# Altium schematic sheet Processor.SchDoc
size 594 x 420 mm; Author: ALTIUM GOSTBOM2.0 KEV; SheetNumber: 17; SheetTotal: 48
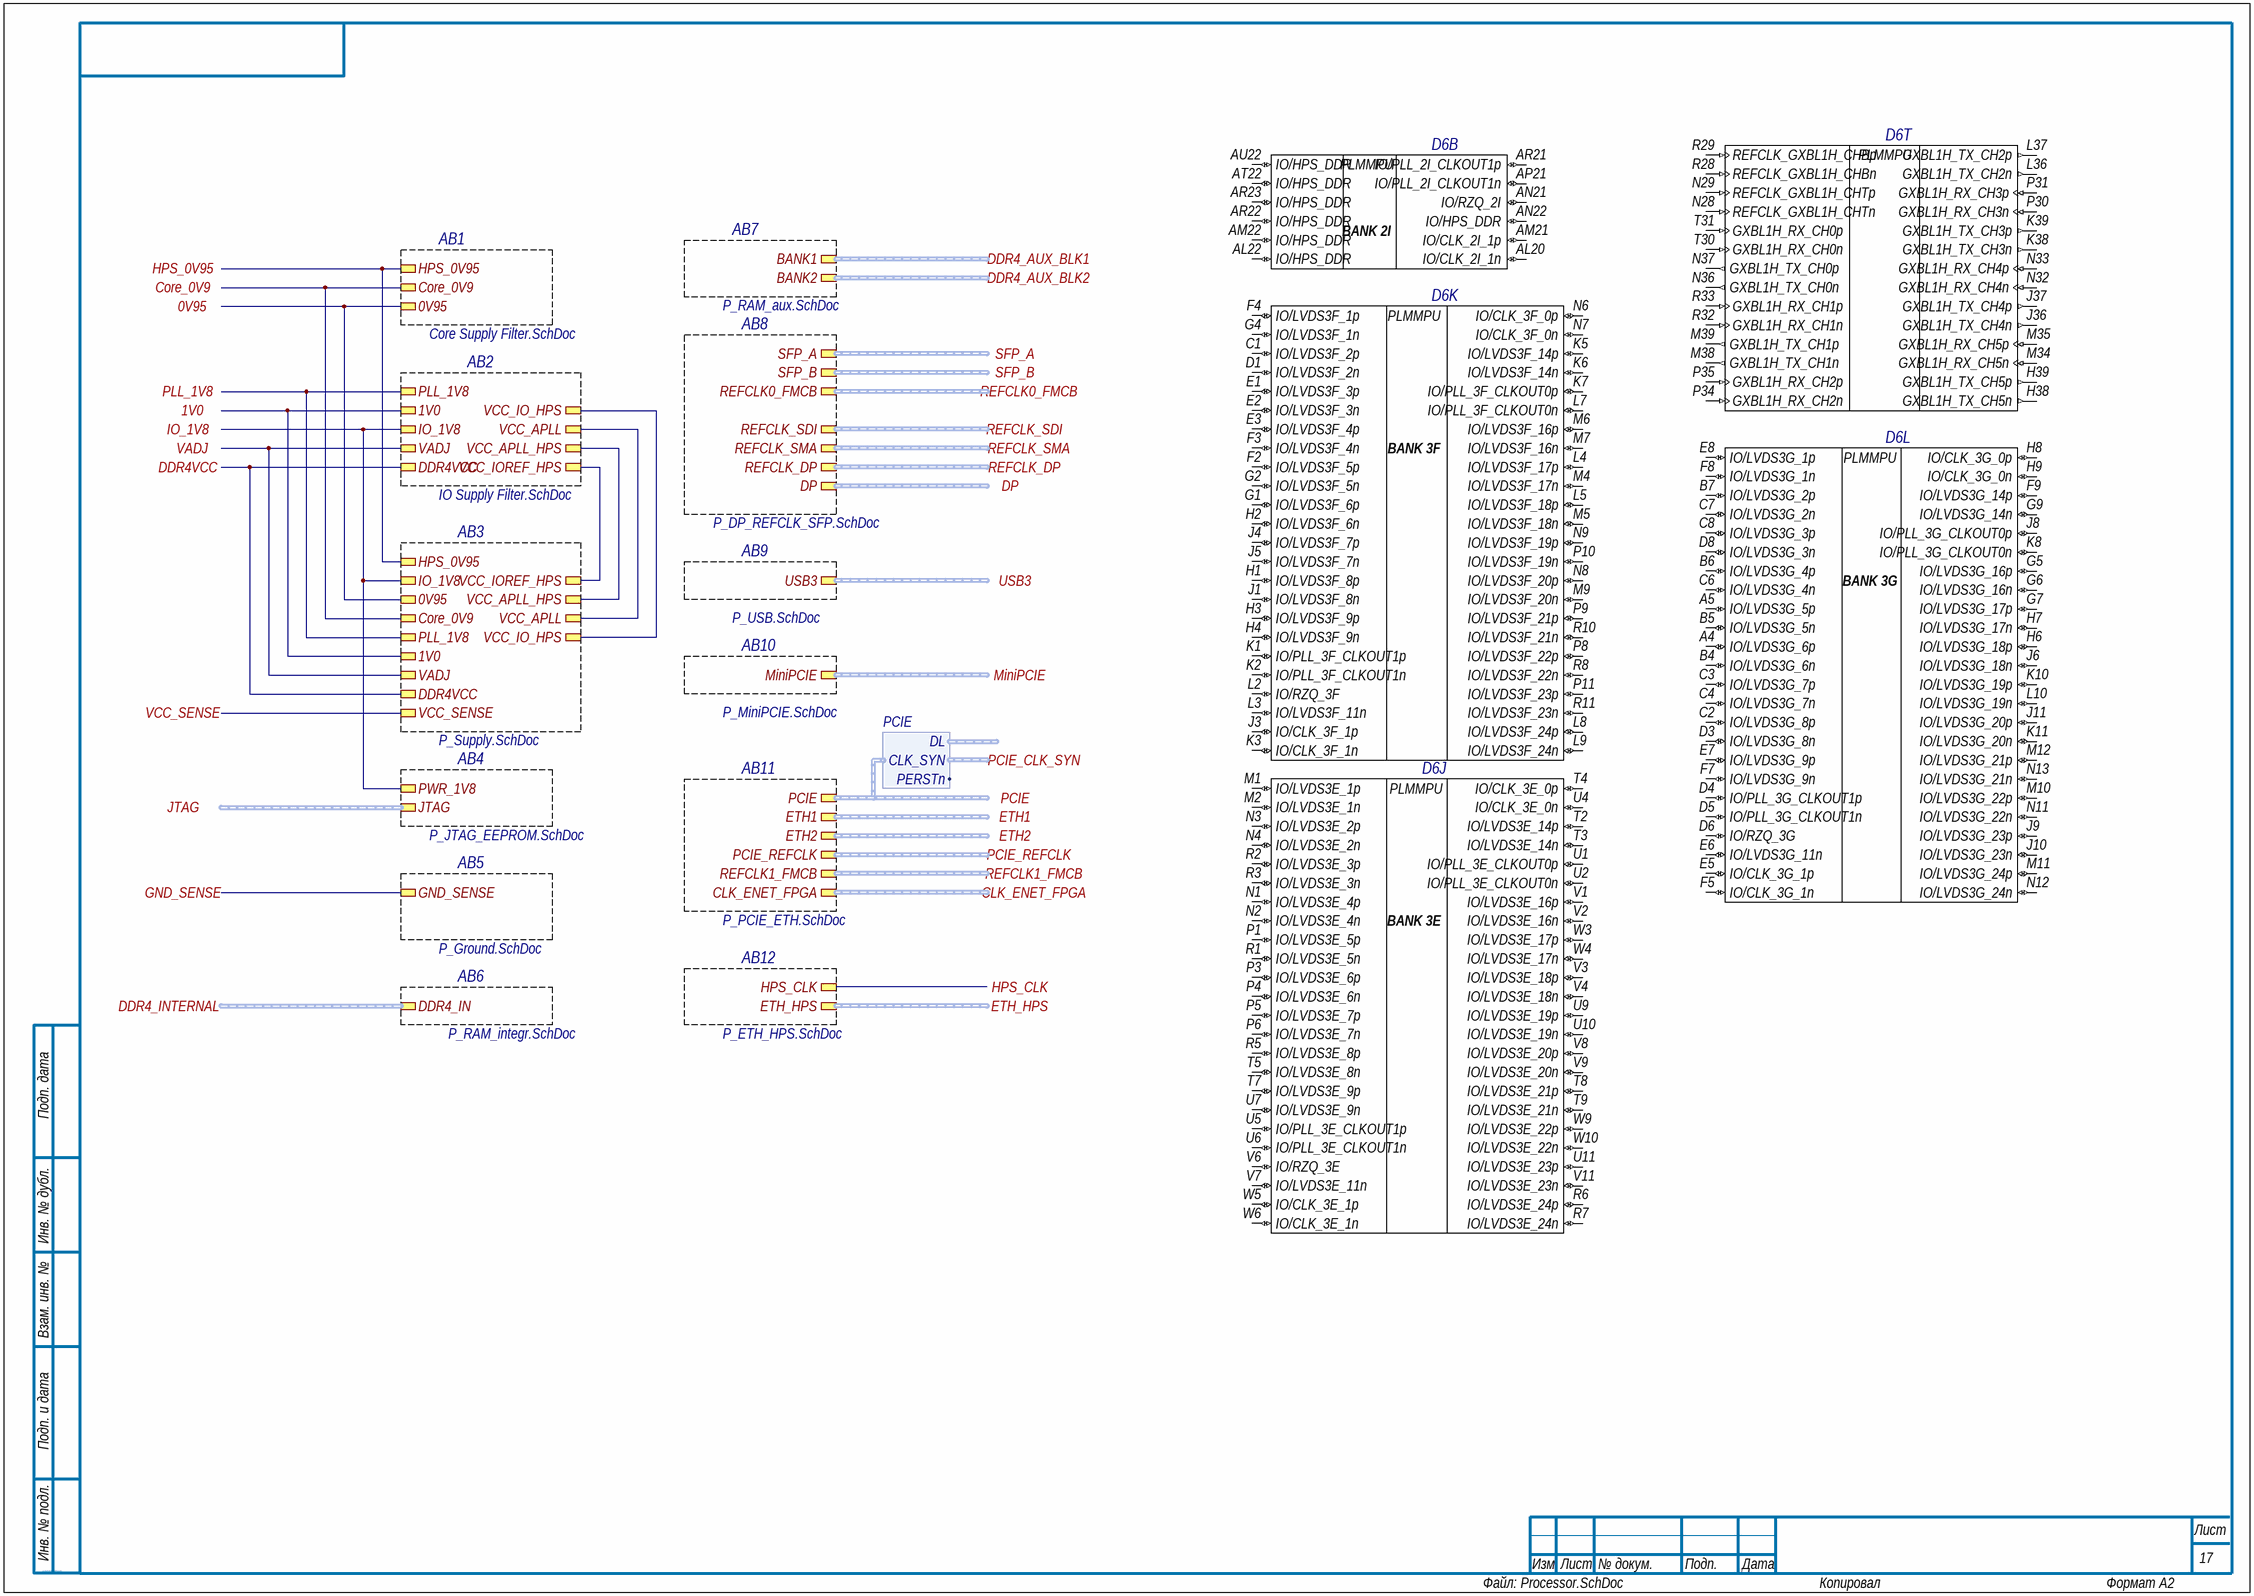
[diagram p0: Processor.SchDoc]

## Parts
D6  10AS066N3F40E2SGE2  [ALTR-FBGA1517_A-350]  (value not drawn)  (parts B,J,K,L,T of 39)

## Sub-sheets
AB1 = Core Supply Filter.SchDoc: HPS_0V95, Core_0V9, 0V95
AB2 = IO Supply Filter.SchDoc: PLL_1V8, 1V0, IO_1V8, VADJ, DDR4VCC, VCC_IO_HPS, VCC_APLL, VCC_APLL_HPS, VCC_IOREF_HPS
AB3 = P_Supply.SchDoc: Core_0V9, PLL_1V8, 1V0, VADJ, DDR4VCC, 0V95, IO_1V8, VCC_IOREF_HPS, VCC_APLL_HPS, VCC_APLL, VCC_IO_HPS, VCC_SENSE, HPS_0V95
AB4 = P_JTAG_EEPROM.SchDoc: JTAG (harness JTAG), PWR_1V8
AB5 = P_Ground.SchDoc: GND_SENSE
AB6 = P_RAM_integr.SchDoc: DDR4_IN (harness DDR4_2C)
AB7 = P_RAM_aux.SchDoc: BANK1 (harness DDR4_SODIMM), BANK2 (harness DDR4_SODIMM)
AB8 = P_DP_REFCLK_SFP.SchDoc: SFP_A (harness SFP), SFP_B (harness SFP), REFCLK0_FMCB (harness DIFFPAIR), REFCLK_SDI (harness DIFFPAIR), REFCLK_SMA (harness DIFFPAIR), REFCLK_DP (harness DIFFPAIR), DP (harness DP_INTERFACE)
AB9 = P_USB.SchDoc: USB3 (harness USB3)
AB10 = P_MiniPCIE.SchDoc: MiniPCIE (harness MiniPCIE)
AB11 = P_PCIE_ETH.SchDoc: PCIE (harness PCIE), ETH1 (harness ETHERNET), ETH2 (harness ETHERNET), PCIE_REFCLK (harness DIFFPAIR), REFCLK1_FMCB (harness DIFFPAIR), CLK_ENET_FPGA (harness DIFFPAIR)
AB12 = P_ETH_HPS.SchDoc: HPS_CLK, ETH_HPS (harness ETHERNET_HPS)

## Ports
0V95, 1V0, CLK_ENET_FPGA (harness DIFFPAIR), Core_0V9, DDR4_AUX_BLK1 (harness DDR4_SODIMM), DDR4_AUX_BLK2 (harness DDR4_SODIMM), DDR4_INTERNAL (harness DDR4_2C), DDR4VCC, DP (harness DP_INTERFACE), ETH1 (harness ETHERNET), ETH2 (harness ETHERNET), ETH_HPS (harness ETHERNET_HPS), GND_SENSE, HPS_0V95, HPS_CLK, IO_1V8, JTAG (harness JTAG), MiniPCIE (harness MiniPCIE), PCIE (harness PCIE), PCIE_CLK_SYN (harness DIFFPAIR), PCIE_REFCLK (harness DIFFPAIR), PLL_1V8, REFCLK0_FMCB (harness DIFFPAIR), REFCLK1_FMCB (harness DIFFPAIR), REFCLK_DP (harness DIFFPAIR), REFCLK_SDI (harness DIFFPAIR), REFCLK_SMA (harness DIFFPAIR), SFP_A (harness SFP), SFP_B (harness SFP), USB3 (harness USB3), VADJ, VCC_SENSE

## Harnesses
PCIE: DL, CLK_SYN, PERSTn

## Nets
0V95: port 0V95, sheet AB1/0V95, sheet AB3/0V95
1V0: port 1V0, sheet AB2/1V0, sheet AB3/1V0
Core_0V9: port Core_0V9, sheet AB1/Core_0V9, sheet AB3/Core_0V9
DDR4VCC: port DDR4VCC, sheet AB2/DDR4VCC, sheet AB3/DDR4VCC
GND_SENSE: port GND_SENSE, sheet AB5/GND_SENSE
HPS_0V95: port HPS_0V95, sheet AB1/HPS_0V95, sheet AB3/HPS_0V95
HPS_CLK: port HPS_CLK, sheet AB12/HPS_CLK
IO_1V8: port IO_1V8, sheet AB2/IO_1V8, sheet AB3/IO_1V8, sheet AB4/PWR_1V8
PLL_1V8: port PLL_1V8, sheet AB2/PLL_1V8, sheet AB3/PLL_1V8
VADJ: port VADJ, sheet AB2/VADJ, sheet AB3/VADJ
VCC_SENSE: port VCC_SENSE, sheet AB3/VCC_SENSE
(unnamed): sheet AB2/VCC_IO_HPS, sheet AB3/VCC_IO_HPS
(unnamed): sheet AB2/VCC_APLL, sheet AB3/VCC_APLL
(unnamed): sheet AB2/VCC_APLL_HPS, sheet AB3/VCC_APLL_HPS
(unnamed): sheet AB2/VCC_IOREF_HPS, sheet AB3/VCC_IOREF_HPS

Not connected (* = marked no-connect by the designer): D6 A4(IO/LVDS3G_6p) A5(IO/LVDS3G_5p) AL20(IO/CLK_2I_1n) AL22(IO/HPS_DDR) AM21(IO/CLK_2I_1p) AM22(IO/HPS_DDR) AN21(IO/RZQ_2I) AN22(IO/HPS_DDR) AP21(IO/PLL_2I_CLKOUT1n) AR21(IO/PLL_2I_CLKOUT1p) AR22(IO/HPS_DDR) AR23(IO/HPS_DDR) AT22(IO/HPS_DDR) AU22(IO/HPS_DDR) B4(IO/LVDS3G_6n) B5(IO/LVDS3G_5n) B6(IO/LVDS3G_4p) B7(IO/LVDS3G_2p) C1(IO/LVDS3F_2p) C2(IO/LVDS3G_8p) C3(IO/LVDS3G_7p) C4(IO/LVDS3G_7n) C6(IO/LVDS3G_4n) C7(IO/LVDS3G_2n) C8(IO/LVDS3G_3p) D1(IO/LVDS3F_2n) D3(IO/LVDS3G_8n) D4(IO/PLL_3G_CLKOUT1p) D5(IO/PLL_3G_CLKOUT1n) D6(IO/RZQ_3G) D8(IO/LVDS3G_3n) E1(IO/LVDS3F_3p) E2(IO/LVDS3F_3n) E3(IO/LVDS3F_4p) E5(IO/CLK_3G_1p) E6(IO/LVDS3G_11n) E7(IO/LVDS3G_9p) E8(IO/LVDS3G_1p) F2(IO/LVDS3F_5p) F3(IO/LVDS3F_4n) F4(IO/LVDS3F_1p) F5(IO/CLK_3G_1n) F7(IO/LVDS3G_9n) F8(IO/LVDS3G_1n) F9(IO/LVDS3G_14p) G1(IO/LVDS3F_6p) G2(IO/LVDS3F_5n) G4(IO/LVDS3F_1n) G5(IO/LVDS3G_16p) G6(IO/LVDS3G_16n) G7(IO/LVDS3G_17p) G9(IO/LVDS3G_14n) H1(IO/LVDS3F_8p) H2(IO/LVDS3F_6n) H3(IO/LVDS3F_9p) H4(IO/LVDS3F_9n) H6(IO/LVDS3G_18p) H7(IO/LVDS3G_17n) H8(IO/CLK_3G_0p) H9(IO/CLK_3G_0n) H38(GXBL1H_TX_CH5n) H39(GXBL1H_TX_CH5p) J1(IO/LVDS3F_8n) J3(IO/CLK_3F_1p) J4(IO/LVDS3F_7p) J5(IO/LVDS3F_7n) J6(IO/LVDS3G_18n) J8(IO/PLL_3G_CLKOUT0p) J9(IO/LVDS3G_23p) J10(IO/LVDS3G_23n) J11(IO/LVDS3G_20p) J36(GXBL1H_TX_CH4n) J37(GXBL1H_TX_CH4p) K1(IO/PLL_3F_CLKOUT1p) K2(IO/PLL_3F_CLKOUT1n) K3(IO/CLK_3F_1n) K5(IO/LVDS3F_14p) K6(IO/LVDS3F_14n) K7(IO/PLL_3F_CLKOUT0p) K8(IO/PLL_3G_CLKOUT0n) K10(IO/LVDS3G_19p) K11(IO/LVDS3G_20n) K38(GXBL1H_TX_CH3n) K39(GXBL1H_TX_CH3p) L2(IO/RZQ_3F) L3(IO/LVDS3F_11n) L4(IO/LVDS3F_17p) L5(IO/LVDS3F_18p) L7(IO/PLL_3F_CLKOUT0n) L8(IO/LVDS3F_24p) L9(IO/LVDS3F_24n) L10(IO/LVDS3G_19n) L36(GXBL1H_TX_CH2n) L37(GXBL1H_TX_CH2p) M1(IO/LVDS3E_1p) M2(IO/LVDS3E_1n) M4(IO/LVDS3F_17n) M5(IO/LVDS3F_18n) M6(IO/LVDS3F_16p) M7(IO/LVDS3F_16n) M9(IO/LVDS3F_20n) M10(IO/LVDS3G_22p) M11(IO/LVDS3G_24p) M12(IO/LVDS3G_21p) M34(GXBL1H_RX_CH5n) M35(GXBL1H_RX_CH5p) M38(GXBL1H_TX_CH1n) M39(GXBL1H_TX_CH1p) N1(IO/LVDS3E_4p) N2(IO/LVDS3E_4n) N3(IO/LVDS3E_2p) N4(IO/LVDS3E_2n) N6(IO/CLK_3F_0p) N7(IO/CLK_3F_0n) N8(IO/LVDS3F_20p) N9(IO/LVDS3F_19p) N11(IO/LVDS3G_22n) N12(IO/LVDS3G_24n) N13(IO/LVDS3G_21n) N28(REFCLK_GXBL1H_CHTn) N29(REFCLK_GXBL1H_CHTp) N32(GXBL1H_RX_CH4n) N33(GXBL1H_RX_CH4p) N36(GXBL1H_TX_CH0n) N37(GXBL1H_TX_CH0p) P1(IO/LVDS3E_5p) P3(IO/LVDS3E_6p) P4(IO/LVDS3E_6n) P5(IO/LVDS3E_7p) P6(IO/LVDS3E_7n) P8(IO/LVDS3F_22p) P9(IO/LVDS3F_21p) P10(IO/LVDS3F_19n) P11(IO/LVDS3F_23p) P30(GXBL1H_RX_CH3n) P31(GXBL1H_RX_CH3p) P34(GXBL1H_RX_CH2n) P35(GXBL1H_RX_CH2p) R1(IO/LVDS3E_5n) R2(IO/LVDS3E_3p) R3(IO/LVDS3E_3n) R5(IO/LVDS3E_8p) R6(IO/LVDS3E_24p) R7(IO/LVDS3E_24n) R8(IO/LVDS3F_22n) R10(IO/LVDS3F_21n) R11(IO/LVDS3F_23n) R28(REFCLK_GXBL1H_CHBn) R29(REFCLK_GXBL1H_CHBp) R32(GXBL1H_RX_CH1n) R33(GXBL1H_RX_CH1p) T2(IO/LVDS3E_14p) T3(IO/LVDS3E_14n) T4(IO/CLK_3E_0p) T5(IO/LVDS3E_8n) T7(IO/LVDS3E_9p) T8(IO/LVDS3E_21p) T9(IO/LVDS3E_21n) T30(GXBL1H_RX_CH0n) T31(GXBL1H_RX_CH0p) U1(IO/PLL_3E_CLKOUT0p) U2(IO/PLL_3E_CLKOUT0n) U4(IO/CLK_3E_0n) U5(IO/PLL_3E_CLKOUT1p) U6(IO/PLL_3E_CLKOUT1n) U7(IO/LVDS3E_9n) U9(IO/LVDS3E_19p) U10(IO/LVDS3E_19n) U11(IO/LVDS3E_23p) V1(IO/LVDS3E_16p) V2(IO/LVDS3E_16n) V3(IO/LVDS3E_18p) V4(IO/LVDS3E_18n) V6(IO/RZQ_3E) V7(IO/LVDS3E_11n) V8(IO/LVDS3E_20p) V9(IO/LVDS3E_20n) V11(IO/LVDS3E_23n) W3(IO/LVDS3E_17p) W4(IO/LVDS3E_17n) W5(IO/CLK_3E_1p) W6(IO/CLK_3E_1n) W9(IO/LVDS3E_22p) W10(IO/LVDS3E_22n)

## Buses and harness runs
harness port CLK_ENET_FPGA = sheet AB11/CLK_ENET_FPGA
harness port DDR4_AUX_BLK1 = sheet AB7/BANK1
harness port DDR4_AUX_BLK2 = sheet AB7/BANK2
harness port DDR4_INTERNAL = sheet AB6/DDR4_IN
harness port DP = sheet AB8/DP
harness port ETH1 = sheet AB11/ETH1
harness port ETH2 = sheet AB11/ETH2
harness port ETH_HPS = sheet AB12/ETH_HPS
harness port JTAG = sheet AB4/JTAG
harness port MiniPCIE = sheet AB10/MiniPCIE
harness port PCIE = sheet AB11/PCIE
harness port PCIE_REFCLK = sheet AB11/PCIE_REFCLK
harness port REFCLK0_FMCB = sheet AB8/REFCLK0_FMCB
harness port REFCLK1_FMCB = sheet AB11/REFCLK1_FMCB
harness port REFCLK_DP = sheet AB8/REFCLK_DP
harness port REFCLK_SDI = sheet AB8/REFCLK_SDI
harness port REFCLK_SMA = sheet AB8/REFCLK_SMA
harness port SFP_A = sheet AB8/SFP_A
harness port SFP_B = sheet AB8/SFP_B
harness port USB3 = sheet AB9/USB3

## Notes on the sheet
- Подп. дата
- Инв. № дубл.
- Взам. инв. №
- Подп. и дата
- Инв. № подл.
- Изм.
- Лист
- № докум.
- Подп.
- Дата
- ALTIUM GOSTBOM2.0 KEV
- Файл:
- Копировал
- Формат А2
- (in symbol E105, part B) PLMMPU; BANK 2I
- (in symbol E105, part J) PLMMPU; BANK 3E
- (in symbol E105, part K) PLMMPU; BANK 3F
- (in symbol E105, part L) PLMMPU; BANK 3G
- (in symbol E105, part T) PLMMPU

## Library data of the parts
D6 = E105: Arria 10 SX Family, 588 I/O Pins, 16 Fractional PLLs, 1517-Pin FBGA, Speed Grade 2, Extended Grade, RoHS; Тип элемента: ПЛИС; Old_des: U1; New_des: D6; UID: E105; Component Kind: Standard; ComponentLink1Description: Manufacturer URL; ComponentLink1URL: https://www.altera.com/; ComponentLink2Description: Datasheet; ComponentLink2URL: https://www.altera.com/content/dam/altera-www/global/en_US/pdfs/literature/hb/arria-10/a10_datasheet.pdf; DatasheetVersion: Rev. 2016-06-24, 06/2016; Mounting Technology: Surface Mount; PackageDescription: 1517-Pin FineLine Ball-Grid Array (FBGA), Body 40 x 40 mm, Pitch 1 mm; PartNumber: 10AS066N3F40E2SGE2; Code_JEDEC: MS-034; ComponentLink3Description: Package Specification; ComponentLink3URL: https://www.altera.com/content/dam/altera-www/global/en_US/pdfs/literature/packaging/04r00461-04.pdf; PackageVersion: Rev. 5.0, 01/2016